# EasyEDA Pro project MSDRV3.eprj, schematic Schematic5
Create Date: 2024-11-23; Page Name: P1; Project Name: MSDRV3; Schematic Name: Schematic5; Update Date: 2024-12-16; Company: EasyEDA.com; Drawn: EasyEDA; Page Size: A4; Part Number: JLCPCB-002; Reviewed: EasyEDA; Version: V0.1
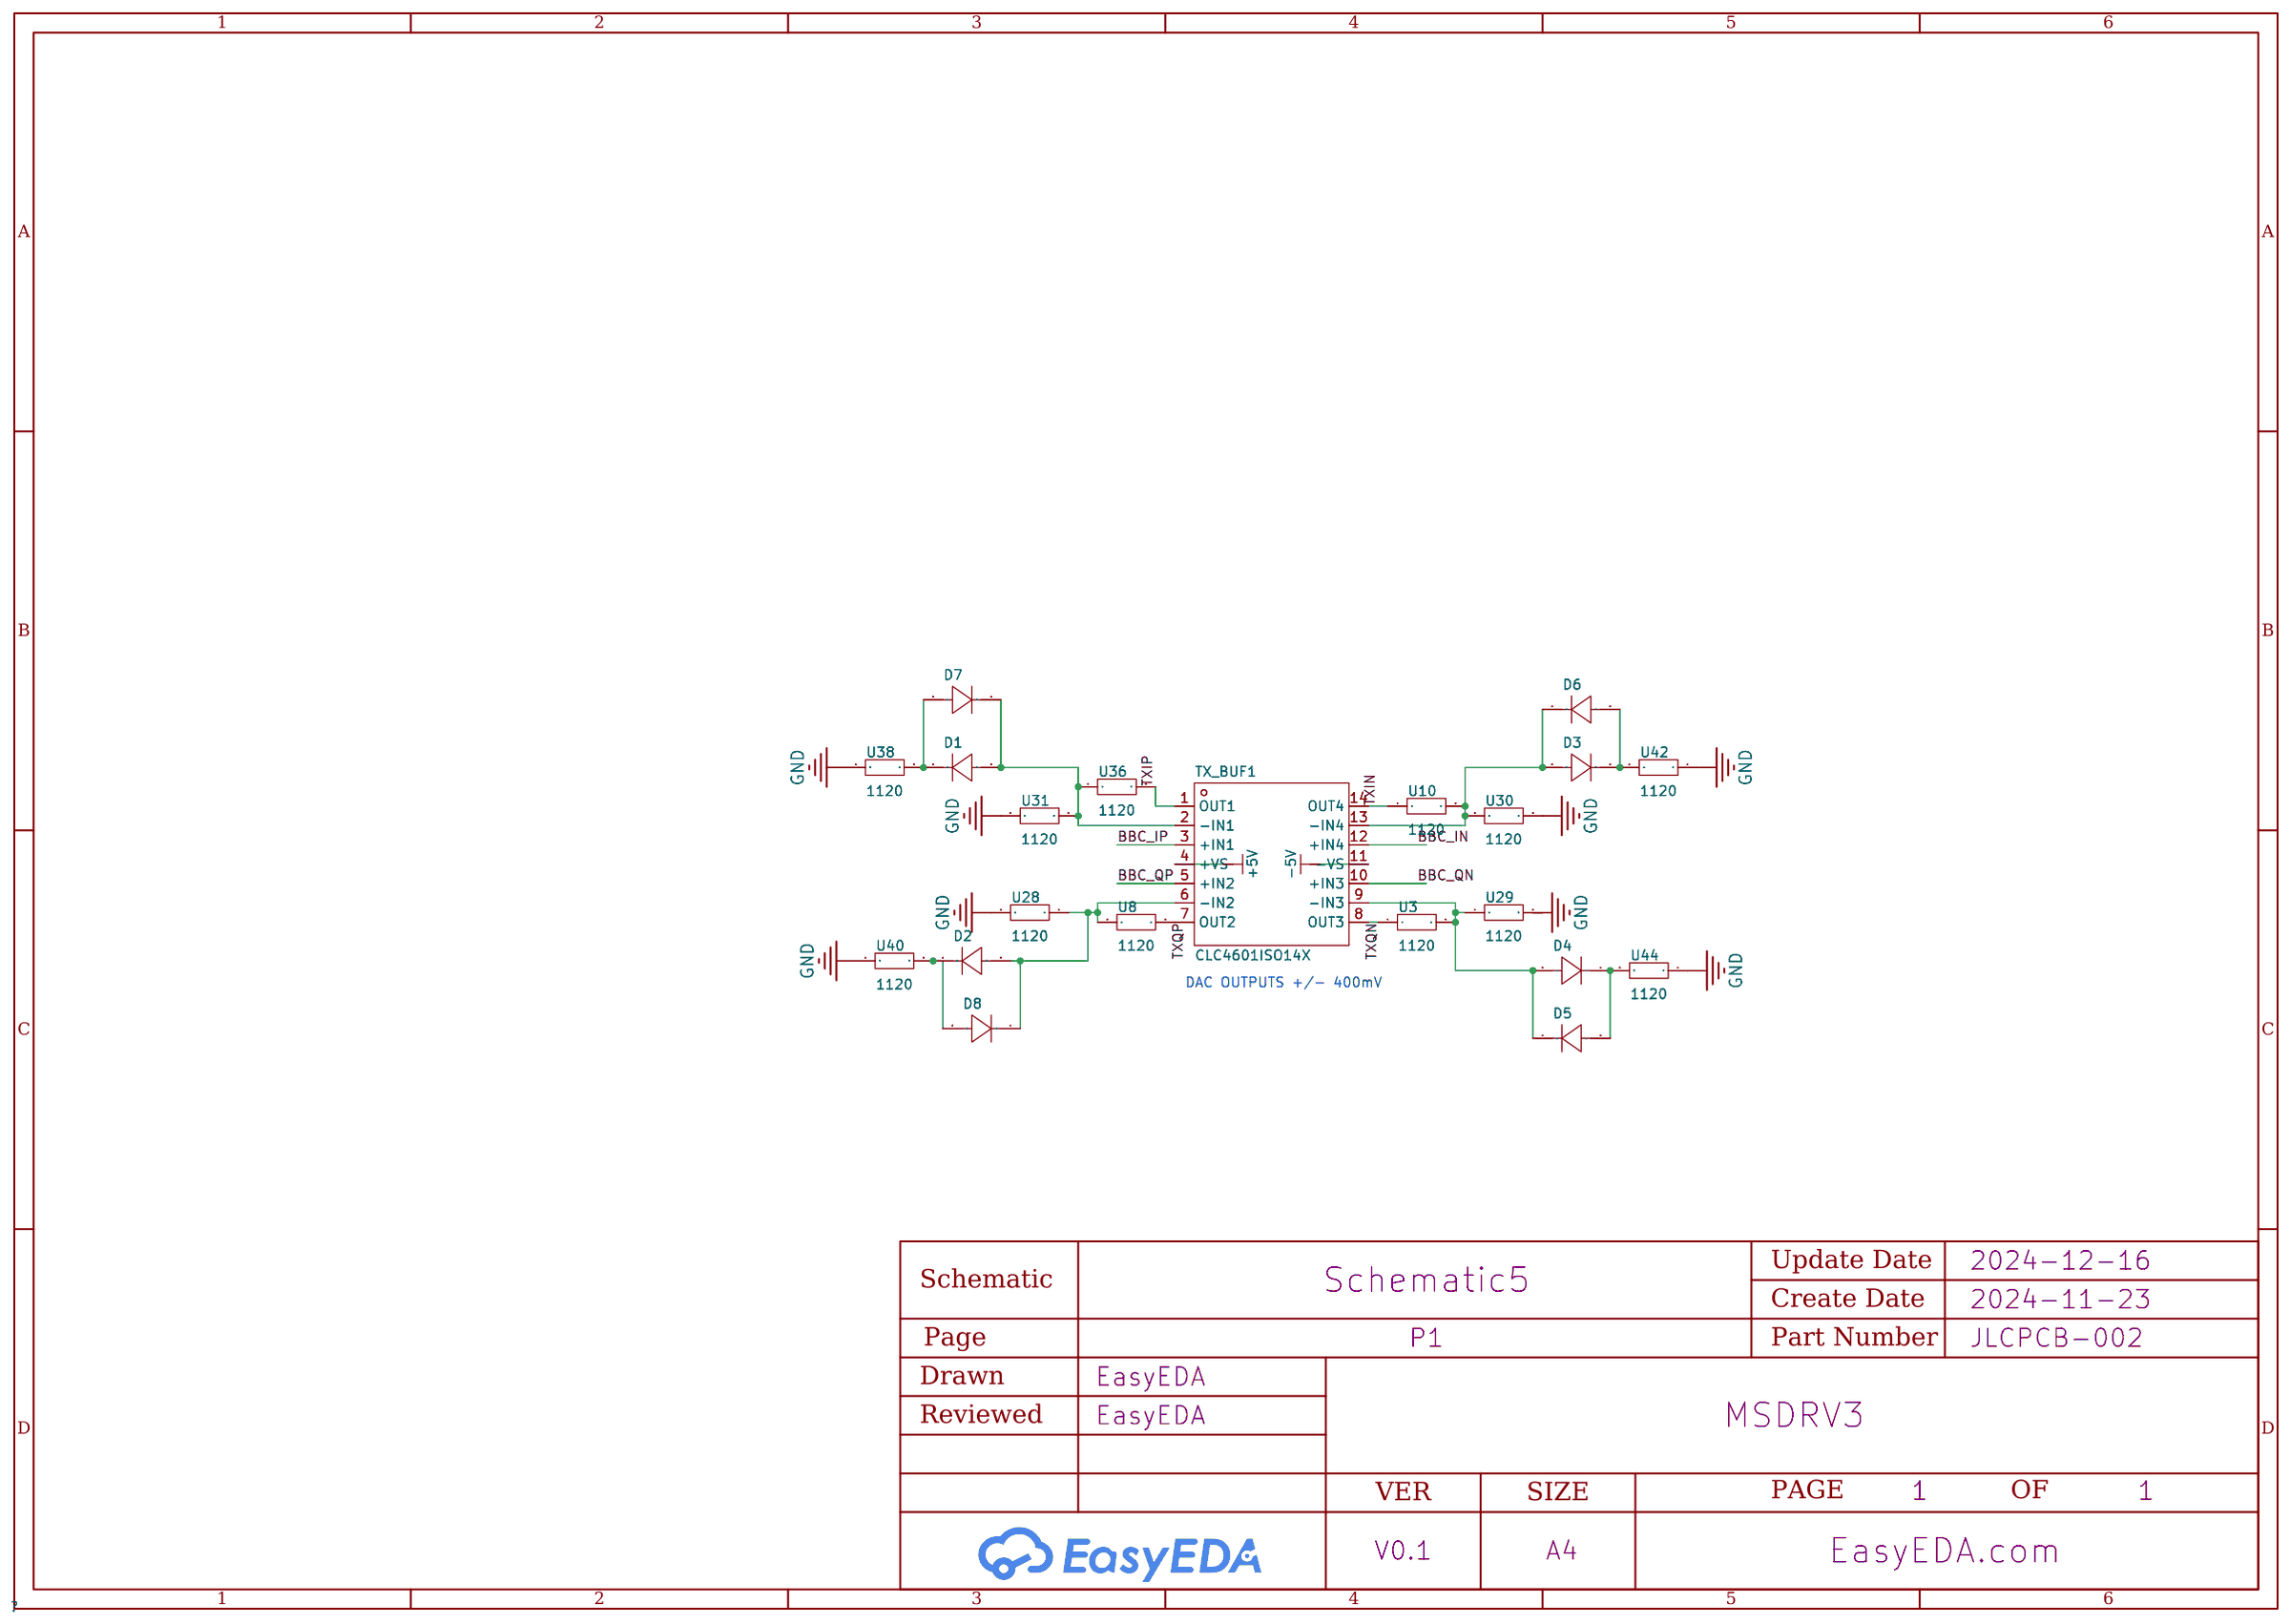
[diagram p5: schematic sheet]

## Parts
D1  -  [SMA_L4.4-W2.8-LS5.4-RD]
D2  -  [SMA_L4.4-W2.8-LS5.4-RD]
D3  -  [SMA_L4.4-W2.8-LS5.4-RD]
D4  -  [SMA_L4.4-W2.8-LS5.4-RD]
D5  -  [SMA_L4.4-W2.8-LS5.4-RD]
D6  -  [SMA_L4.4-W2.8-LS5.4-RD]
D7  -  [SMA_L4.4-W2.8-LS5.4-RD]
D8  -  [SMA_L4.4-W2.8-LS5.4-RD]
TX_BUF1  CLC4601ISO14X  [SOIC-14_L8.7-W3.9-P1.27-LS6.0-BL]
U3  1120  [R0805]
U8  1120  [R0805]
U10  1120  [R0805]
U28  1120  [R0805]
U29  1120  [R0805]
U30  1120  [R0805]
U31  1120  [R0805]
U36  1120  [R0805]
U38  1120  [R0805]
U40  1120  [R0805]
U42  1120  [R0805]
U44  1120  [R0805]

## Library data of the parts
D1-D8 = 1N4007: Supplier Footprint: SMA(DO-214AC); Supplier Part: C727081
TX_BUF1 = CLC4601ISO14X: Number of Circuits:; Supplier Part: C49944; Supplier Footprint: SOIC-14; JLCPCB Part Class: Extended Part; Supplier: LCSC
U3 U8 U10 U28-U31 U36 U38 U40 U42 U44 = 3R00: Supplier Part: C9900008006; JLCPCB Part Class: Extended Part; Supplier: LCSC

## Nets
+5V: TX_BUF1.4(+VS)
-5V: TX_BUF1.11(-VS)
GND: U28.2 U29.2 U30.2 U31.1 U38.1 U40.1 U42.1 U44.1
BBC_IN: TX_BUF1.12(+IN4)
BBC_IP: TX_BUF1.3(+IN1)
BBC_QN: TX_BUF1.10(+IN3)
BBC_QP: TX_BUF1.5(+IN2)
TXIN: TX_BUF1.14(OUT4) U10.1
TXIP: TX_BUF1.1(OUT1) U36.2
TXQN: TX_BUF1.8(OUT3) U3.1
TXQP: TX_BUF1.7(OUT2) U8.2
$1N1556: D4.1(K) D5.2(A) U44.2
$1N1561: D4.2(A) D5.1(K) TX_BUF1.9(-IN3) U3.2 U29.1
$1N1594: D3.2(A) D6.1(K) TX_BUF1.13(-IN4) U10.2 U30.1
$1N1617: D3.1(K) D6.2(A) U42.2
$1N1646: D1.2(A) D7.1(K) TX_BUF1.2(-IN1) U31.2 U36.1
$1N1669: D1.1(K) D7.2(A) U38.2
$1N1698: D2.2(A) D8.1(K) TX_BUF1.6(-IN2) U8.1 U28.1
$1N1729: D2.1(K) D8.2(A) U40.2

## Notes on the sheet
- DAC OUTPUTS +/- 400mV
